# EasyEDA Pro project 硬触发测试_2024-02-21_17-27-05(1).eprj, board PCB1 (continued)
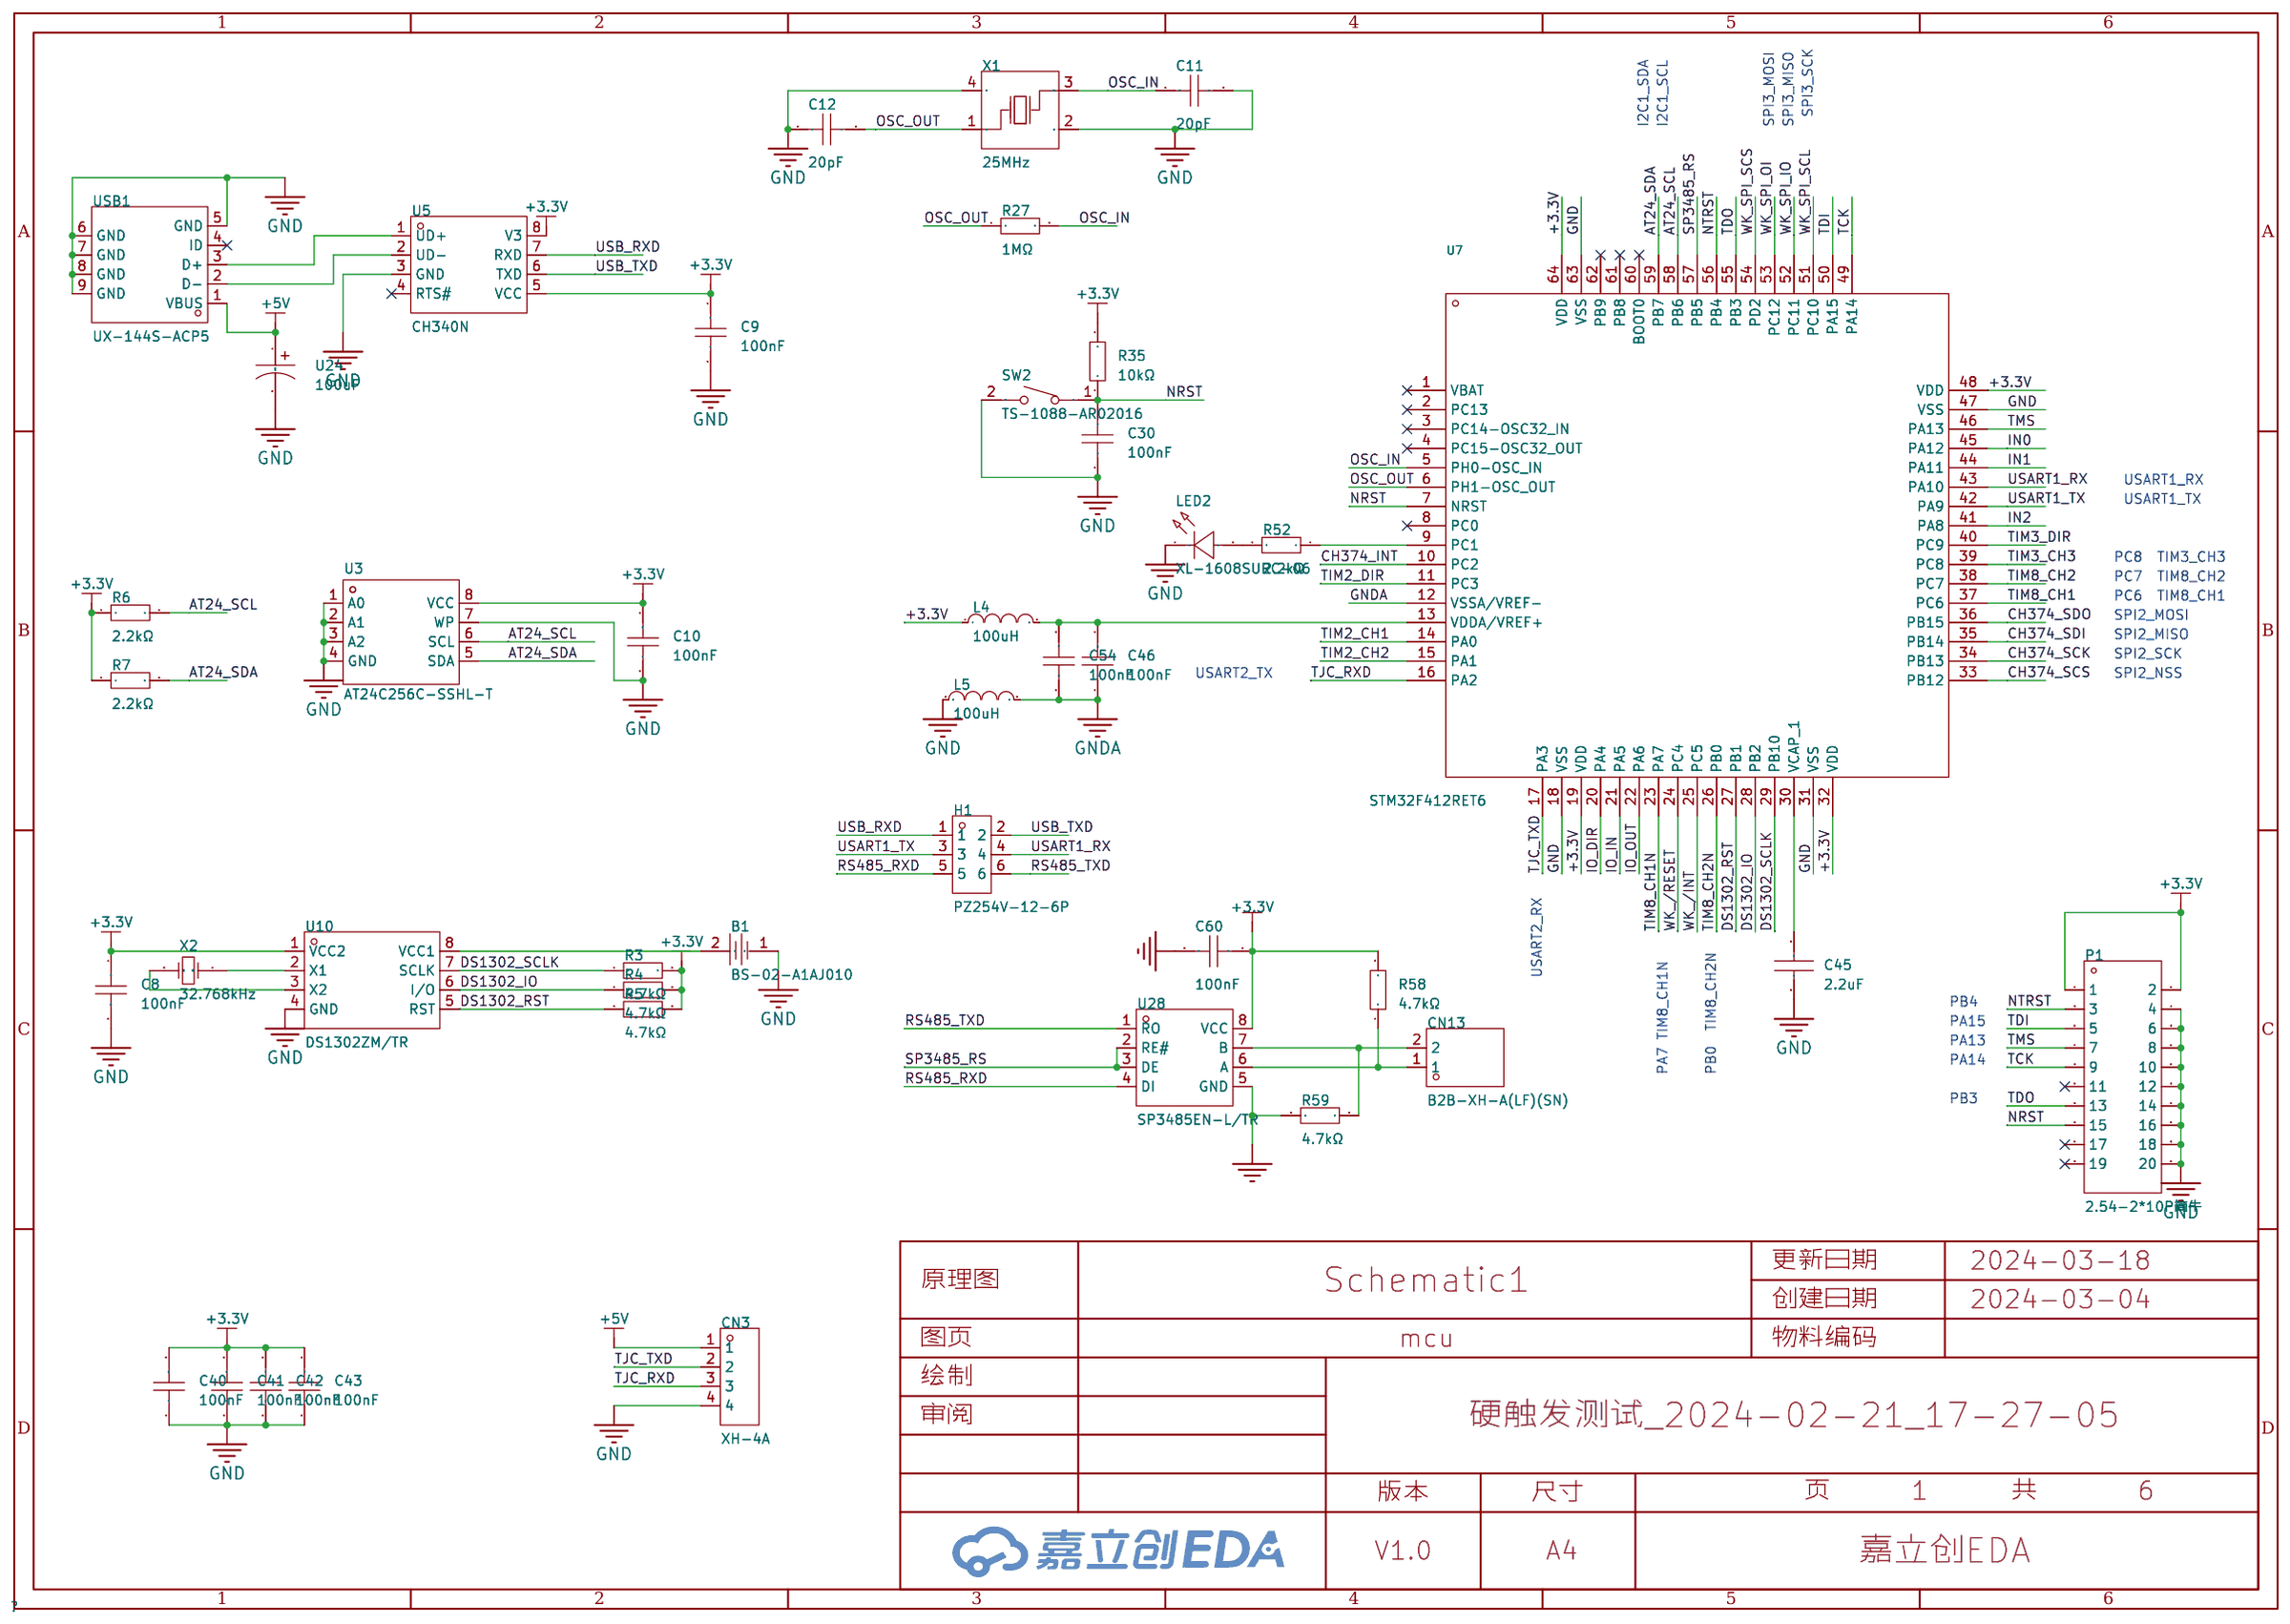
[diagram p0: mcu]
## Routing (per net, layer and track width the routed paths; a pad name or vN(x,y) marks a point on that pad's centre or on a via; arc(x,y) is an arc through that point)
+3.3V: length 416.4
  Top Layer w0.254: 41.13,13.71 41.13,17.59 53.65,30.1 55.63,30.1 57.28,31.75 v1(57.4,31.75) 57.4,28.33 56.64,27.56 56.64,19.92 ; 41.13,13.71 U9.1 ; 41.13,13.71 41.02,13.82 ; v1(61.34,58.3) 61.34,56.36 C43.2 61.51,56.14 60.71,56.14 60.26,56.59 U7.32 ; v1(61.34,58.3) 60.71,58.93 60.71,60.33 61.72,61.35 65.53,61.35 68.83,64.65 71.75,64.65 72.71,65.6 C9.1 72.77,66.74 U5.8 ; v1(61.34,58.3) 62.1,59.06 66.17,59.06 67.18,58.04 R3.2 ; 29.04,68.33 29.08,68.29 29.08,64.01 31.5,61.6 38.35,61.6 v1(39.5,60.46) ; 29.04,68.33 28.45,68.33 27.56,69.22 27.56,73.16 27.93,73.53 R48.2 38.74,73.53 R46.2 46.35,73.66 R44.2 v1(47.42,72.59) 47.94,72.08 C33.1 48.51,71.38 47.62,70.49 47.62,67.82 47.81,67.64 U14.5 ; 29.04,68.33 U3.8 33.09,68.33 C10.1 ; 75.31,18.06 75.21,18.17 71.88,18.17 ; 75.31,18.06 76.58,18.06 76.84,17.81 ; 75.31,18.06 75.31,16.38 ; 71.88,18.17 71.88,16.38 72.65,16.38 72.9,16.13 72.9,14.23 72.5,13.84 U27.1 72.53,12.96 73.91,12.96 74.17,12.71 74.17,11.93 ; 71.88,18.17 70.99,18.17 70.74,18.42 ; U28.8 79.46,13.66 C60.1 77.85,12.2 77.47,12.58 77.47,13.1 U26.1 77.46,13.96 77.72,14.23 77.72,16.26 77.6,16.39 76.84,16.39 R57.2 76.84,17.81 ; 65.34,14.93 64.64,14.23 64.64,13.5 64.63,13.49 ; 65.34,14.93 65.34,17.53 65.09,17.78 60.08,17.78 59.82,17.53 ; 65.34,14.93 C59.2 R54.1 ; L4.1 58.68,38.29 v1(61.47,38.29) ; 56.64,19.92 56.24,19.92 53.34,17.02 53.34,8.26 52.96,7.88 SW1.3 ; 56.64,19.92 69.24,19.92 70.74,18.42 ; 56.64,19.92 56.64,18.36 57.22,17.78 59.56,17.78 59.82,17.53 ; 59.82,17.53 C8.1 59.88,15.12 U20.1 61.07,13.29 C58.1 ; U14.19 U14.20 58.23,70.24 C34.1 59.06,70.94 v1(59.06,71.38) ; 76.84,17.81 77.85,18.82 77.85,20.58 R58.2 77.84,20.58 76.84,20.58 76.2,21.21 R35.2 ; 70.74,18.42 70.74,18.32 70.36,17.93 R42.2 ; P1.1 P1.2 78.74,38.11 75.18,38.11 70.87,42.42 67.82,42.42 66.39,43.85 U10.1 64.45,47.82 63.63,48.65 v1(61.59,48.65) 61.59,48.59 61.56,48.56 C42.2 60.38,49.66 59.95,50.09 U7.19 ; U7.64 44.05,49.09 43.98,49.15
  Top Layer w0.305: U7.48 48.19,59.74 48.25,59.79 C41.2 47.08,60.55 v1(46.99,60.46)
  Top Layer w0.508: 36.7,50.19 38.66,50.19 39.66,51.19 42.67,51.19 43.98,49.88 43.98,49.15 ; 36.7,50.19 36.7,57.66 v1(39.5,60.46) ; 36.7,50.19 C52.1 ; R3.2 R4.2 R5.2 ; U4.2 30.48,44.54 36.24,44.54 C52.1 ; C10.1 33.15,68.12 R6.1 R7.1 ; C52.1 39.75,44.08 40.77,43.06 40.77,37.47 44.96,33.28 55.88,33.28 v1(57.4,31.75) ; U5.8 72.77,71.25 72.52,71.51 69.47,71.51 68.96,71 U5.5
  Bottom Layer w0.254: v1(47.42,72.59) 48,72.01 50.55,72.01 53.59,75.06 58.67,75.06 59.82,73.92 59.82,72.14 v1(59.06,71.38)
  Bottom Layer w0.508: v1(39.5,60.46) v1(46.99,60.46) 46.99,59.44 47.24,59.19 60.45,59.19 v1(61.34,58.3) ; v1(61.59,48.65) 61.59,38.41 v1(61.47,38.29) 57.4,38.29 v1(57.4,31.75)
+5V: length 296.9
  Top Layer w0.254: 73.15,10.16 72.87,9.88 U27.8 ; U16.8 64.63,10.05 64.9,9.78 65.91,9.78 v1(66.17,10.04) C56.2 ; 60.58,10.55 60.53,10.59 59.88,10.59 ; C57.2 79.32,10.18 v1(78.24,10.18) 78.08,10.01 U26.8
  Top Layer w0.508: 59.82,78.49 49.15,78.49 48.01,77.35 48.01,76.38 46.18,74.55 24.89,74.55 23.37,73.03 23.37,63.25 23.88,62.74 27.43,62.74 28.96,61.22 28.96,53.85 28.19,53.09 28.19,50.22 U4.3 ; 59.82,78.49 59.75,78.55 62.23,81.03 68.2,81.03 68.83,81.67 78.49,81.67 79.5,80.65 79.5,75.19 78.35,74.03 U24.1 ; 59.82,78.49 60.96,77.35 60.96,73.4 USB2.1 61.03,71.05 62.37,69.72 U25.1 ; U24.1 75.07,74.03 74.39,74.72 USB1.1 ; U24.1 77.34,72.01 77.72,71.63 78.68,71.63 79.76,70.56 79.76,67.95 85.6,62.11 85.6,32.64 ; v1(4.44,52.08) R1.2 ; U4.3 28.09,50.3 21.59,50.3 20.7,49.41 20.7,44.71 19.41,43.41 L1.2 v1(12.32,46.61) ; U4.3 28.18,44.31 25.92,42.06 U12.3 28.67,38.57 C13.2 ; 85.6,32.64 85.54,32.58 CN3.1 ; 85.6,32.64 85.6,26.55 84.58,25.53 84.58,20.71 81.91,18.04 81.91,14.1 82.42,13.59 82.42,9.28 81.53,8.39 80.14,8.39 79.5,9.02 79.5,10.23 C57.2
  Bottom Layer w0.254: SW1.1 52.14,3.88 54.74,6.48 54.74,8.81 56.47,10.55 v1(60.56,10.55) 65.66,10.55 v1(66.17,10.04) 66.3,10.18 v1(73.11,10.18) v1(78.24,10.18)
  Bottom Layer w0.508: v1(4.44,52.08) 6.86,52.08 7.6,51.33 7.6,48.28 9.27,46.61 v1(12.32,46.61)
  vias: v1(7.37,33.41)
GND: length 77.2
  Top Layer w0.254: v1(31.12,33.03) 30.99,32.9 30.99,29.34 30.09,28.44 U2.29 ; U2.9 30.59,15.39 30.67,15.31 ; v1(60.71,16.77) 62.1,16.77 62.61,16.26 62.61,14.99 63.13,14.47 63.13,13.49 ; 27.59,18.74 27.59,17.94 27.18,17.53 25.91,17.53 25.4,18.04 v1(25.4,18.17) ; 30.67,15.31 30.73,15.25 33.65,15.25 R29.1 ; 30.67,15.31 C21.1 ; v1(44.45,50.81) 44.45,50.2 45.07,49.59 U7.63 ; v1(60.45,48.39) 60.45,48.77 59.64,49.59 U7.18 ; U2.14 34.46,20.74 35.01,20.2 36.83,20.2 37.08,19.94 37.08,19.37 C22.1 ; C45.1 62.65,56.15 C43.1 62.63,55.65 62.48,55.5 60.58,55.5 60,56.09 U7.31 ; P1.4 P1.6 P1.8 P1.10 P1.12 P1.14 P1.16 P1.18 P1.20 ; 35.18,22.61 35.18,22.36 34.56,21.74 U2.16 ; 35.18,22.61 34.8,22.99 34.8,23.12 34.68,23.24 U2.19 ; 35.18,22.61 36.7,22.61 37.02,22.93 C23.1 ; C41.1 48.86,61.64 49.02,61.47 49.02,60.04 48.69,59.71 U7.47 ; U27.4 69.88,12.99 v1(69.85,12.96) ; R26.2 R25.2 R31.1 19.43,24.9 v1(18.92,25.41)
  vias: v1(2.41,52.08) v1(3.3,52.08) v1(3.43,45.72) v1(3.43,44.45) v1(4.49,45.7) v1(4.49,44.46) v1(5.46,45.72) v1(5.46,44.45) v1(8.25,26.29) v1(8.51,20.2) v1(10.92,27.56) v1(14.86,29.72) v1(17.05,27.05) v1(17.53,79.13) v1(20.7,17.4) v1(22.48,18.93) v1(22.61,28.83) v1(22.73,30.1) v1(24.51,26.55) v1(24.77,71.89) v1(25.4,27.94) v1(27.69,21.09) v1(28.52,30.85) v1(29.34,21.85) v1(29.72,67.06) v1(29.84,69.6) v1(33.91,70.48) v1(36.96,64.27) v1(38.61,32.39) v1(40.51,9.4) v1(41.15,70.11) v1(41.53,49.15) v1(43.31,41.83) v1(46.74,70.24) v1(46.99,61.73) v1(51.31,69.22) v1(51.82,65.16) v1(52.96,70.49) v1(53.59,35.06) v1(53.59,31.75) v1(53.59,26.93) v1(54.36,69.22) v1(58.04,47) v1(58.42,67.44) v1(61.59,9.66) v1(63.37,58.17) v1(65.02,49.79) v1(65.02,27.44) v1(65.15,58.17) v1(67.18,16.51) v1(67.44,12.83) v1(75.06,71.89) v1(75.06,70.62) v1(75.06,69.22) v1(75.06,12.96) v1(77.09,44.58) v1(77.22,47.12) v1(77.85,26.55) v1(79.25,19.06) v1(85.34,19.18) v2(3.51,61.14) v2(3.51,24.72) v2(3.63,83.33) v2(3.69,3.88) v2(71.01,61.22) v2(71.01,24.72) v2(83.13,83.33) v2(83.19,3.88)
GNDA: length 10
  Top Layer w0.254: L5.2 56.13,40.42 56.13,41.79 56.39,42.04 C54.1 57.02,42.08 57.02,43.82 56.64,44.2 54.83,44.2 53.69,45.33 U7.12
+IN0: length 4.2
  Top Layer w0.254: R45.2 46.61,80.19 44.55,82.25
+IN1: length 4.1
  Top Layer w0.254: CN6.1 38.11,80.78 R47.2
+IN2: length 4.9
  Top Layer w0.254: R49.2 30.48,78.75 30.48,81.54 29.77,82.25 CN7.1
-IN0: length 3.8
  Top Layer w0.254: 41.28,78.74 41.28,80.52 42.01,81.26 42.01,82.25
-IN1: length 3.7
  Top Layer w0.254: CN6.2 34.1,78.8 U22.2
-IN2: length 3.8
  Top Layer w0.254: CN7.2 26.29,82.09 U23.2
ACTLED: length 35.3
  Top Layer w0.254: U2.27 31.09,22.84 30.1,21.85 v1(30.1,20.83)
  Bottom Layer w0.254: v1(30.1,20.83) 30.1,19.82 29.74,19.46 29.74,14.51 23.5,8.26 13.1,8.26 J1.10
AT24_SCL: length 26.8
  Top Layer w0.254: U3.6 31.22,65.3 31.37,65.16 32.52,65.16 R6.2 33.9,65.28 39.12,65.28 41.91,62.49 41.91,53.47 43.29,52.09 U7.58
AT24_SDA: length 27
  Top Layer w0.254: 34.76,63.25 31.88,63.25 31.22,63.91 U3.5 ; 34.76,63.25 40,63.25 41.28,61.98 41.28,53.47 43.16,51.59 U7.59 ; 34.76,63.25 34.8,63.29 R7.2
CH374_INT: length 43.8
  Top Layer w0.254: U7.10 52.69,48.28 53.95,49.54 53.95,53.7 54.55,54.3 55.69,54.3 56.18,54.79 56.18,57.45 56.68,57.95 56.68,61.63 59.95,64.91 59.95,73.66 58.93,74.68 53.47,74.68 50.67,71.88 49.91,71.88 49.22,71.2 U14.1
CH374_SCK: length 10.7
  Top Layer w0.254: U7.34 55.19,61.53 54.13,62.59 54.13,66.58 54.54,66.99 U14.15
CH374_SCS: length 9.2
  Top Layer w0.254: U7.33 55.69,61.79 54.48,63 54.48,65.54 54.64,65.69 U14.13
CH374_SDI: length 11.5
  Top Layer w0.254: U7.35 54.69,61.52 53.77,62.44 53.77,66.98 54.43,67.64 U14.16
CH374_SDO: length 12.3
  Top Layer w0.254: U7.36 54.19,61.51 53.42,62.29 53.42,67.39 54.31,68.29 U14.17
CH374T_XI: length 8.9
  Top Layer w0.254: C32.2 44.29,70.23 44.29,68.34 44.32,68.31 44.32,67.57 44.7,67.19 46.99,67.19 47.62,66.55 47.62,65.69 U14.8
CH374T_XO: length 5.8
  Top Layer w0.254: C31.2 45.99,64.41 X4.3 46.02,66.17 46.99,66.17 47.12,66.05 47.12,65.54 47.61,65.04 U14.9
DS1302_IO: length 16
  Top Layer w0.254: R4.1 68.93,55.13 U10.6 68.93,52.13 68.39,51.59 62.84,51.59 59.85,54.59 U7.28
DS1302_RST: length 17.7
  Top Layer w0.254: R5.1 70.29,53.28 U10.5 70.2,51.49 69.94,51.24 62.7,51.24 59.83,54.11 57.71,54.11 U7.27
DS1302_SCLK: length 14.7
  Top Layer w0.254: R3.1 67.66,54.87 U10.7 67.66,52.3 67.31,51.95 62.99,51.95 59.85,55.09 U7.29
IN0: length 29
  Top Layer w0.254: 31.24,71.89 31.24,70.62 32.26,69.6 35.94,69.6 42.77,62.77 48.31,62.77 48.82,62.26 48.87,62.26 49.69,61.44 U7.45 ; 31.24,71.89 R48.1 ; 31.24,71.89 U23.4
IN1: length 23.7
  Top Layer w0.254: U7.44 50.19,61.44 48.51,63.12 43.43,63.12 38.86,67.69 R46.1 38.73,72.02 U22.4
IN2: length 25
  Top Layer w0.254: R44.1 43.94,72.02 U21.4 43.18,72.14 42.29,71.25 42.29,65.03 43.69,63.63 50.29,63.63 51.69,62.23 U7.41
IO_DIR: length 48.1
  Top Layer w0.254: v1(54.86,22.99) 53.57,22.99 45.59,15.02 45.59,13.85 45.21,13.47 45.21,12.45 45.45,12.21 U9.5 ; U7.20 59.47,50.59 v1(59.56,50.68)
  Bottom Layer w0.254: v1(59.56,50.68) 54.86,45.98 v1(54.86,22.99)
IO_IN: length 44.7
  Top Layer w0.254: v1(55.75,50.17) 56.67,51.09 U7.21 ; v1(53.59,24.26) 44.45,15.12 44.45,13.97 43.68,13.21 U9.2
  Bottom Layer w0.254: v1(53.59,24.26) 54.15,24.82 54.15,47.05 55.75,48.65 v1(55.75,50.17)
IO_OUT: length 48
  Top Layer w0.254: v1(54.23,23.63) 53.47,23.63 44.96,15.12 44.96,13.72 43.95,12.71 U9.3 ; U7.22 59.08,51.59 59.1,51.57 v1(59.31,51.57)
  Bottom Layer w0.254: v1(59.31,51.57) 54.51,46.77 54.51,23.91 v1(54.23,23.63)
LINKLED: length 27.9
  Top Layer w0.254: U2.25 32.09,26.5 31.5,25.91 31.5,21.09 v1(31.12,20.71)
  Bottom Layer w0.254: J1.11 20.89,7.88 23.75,7.88 30.1,14.23 30.1,19.31 31.12,20.33 v1(31.12,20.71)
NRST: length 102.7
  Top Layer w0.254: C30.1 78.55,29.28 78.74,29.09 78.74,28.83 78.99,28.58 SW2.1 ; v1(49.78,52.96) 49.78,50.17 51.18,48.77 51.18,47.1 U7.7 51.19,45.71 53.72,43.19 53.72,36.93 58.55,32.11 58.55,23.28 59.34,22.48 64.76,22.48 67.69,25.41 67.69,27.58 68.71,28.61 73.42,28.61 74.16,29.34 R35.1 77.6,29.34
  Bottom Layer w0.254: P1.15 80.14,54.74 73.79,54.74 71.12,57.41 47.5,57.41 46.74,56.65 46.74,53.47 47.75,52.46 48.63,52.46 49.14,52.96 v1(49.78,52.96)
NTRST: length 43.5
  Top Layer w0.254: U7.56 48.51,53.09 v1(48.51,53.09)
  Bottom Layer w0.254: P1.3 80.14,42.04 78.47,42.04 76.2,44.31 76.2,49.03 71.63,53.6 49.02,53.6 v1(48.51,53.09)
OSC_IN: length 14.8
  Top Layer w0.254: U7.5 50.19,45.46 49.54,44.81 46.84,44.81 45.86,43.83 R27.2 46.48,42.03 46.48,39.25 46.22,38.98 X1.3 45.44,39.03 C11.1
OSC_OUT: length 11.2
  Top Layer w0.254: C12.2 47.86,40.56 X1.1 47.37,41.05 47.37,42.65 ; 47.37,42.65 R27.1 ; 47.37,42.65 47.37,44.07 47.62,44.33 49.56,44.33 50.69,45.45 50.67,45.47 50.67,47.07 U7.6
OUT1: length 2.5
  Top Layer w0.254: 77.92,7.88 76.96,8.84 U26.7
OUT2: length 2.6
  Top Layer w0.254: 75.42,7.88 76.46,8.92 U26.6
OUT3: length 2.4
  Top Layer w0.254: 72.92,7.88 72,8.79 U27.7
OUT4: length 2.5
  Top Layer w0.254: 70.42,7.88 71.5,8.97 U27.6
PMODE0: length 27.2
  Top Layer w0.254: R29.2 v1(34.91,16.76) 37.2,16.76 38.23,17.78 38.23,20.96 37.97,21.21 R32.1 ; v1(26.54,23.12) 26.54,22.36 25.93,21.74 25.09,21.74
  Bottom Layer w0.254: v1(34.91,16.76) 34.91,22.5 33.53,23.88 30.92,23.88 29.78,22.74 27.24,22.74 26.86,23.12 v1(26.54,23.12)
PMODE1: length 9.7
  Top Layer w0.254: 25.09,22.24 24.14,22.24 23.62,21.72 23.62,17.15 23.88,16.9 24.38,16.9 24.51,16.76 R30.2 R33.1
PMODE2: length 8.6
  Top Layer w0.254: 25.09,22.74 25.08,22.74 23.75,22.74 23.47,22.46 23.47,22.21 22.99,21.72 19.94,21.72 19.43,22.23 R31.2 R34.1
RCT: length 17.8
  Top Layer w0.254: 12.83,21.59 12.7,21.59 12.32,21.21 11.18,21.21 10.41,21.98 10.41,25.79 10.98,26.36 C20.1 ; 12.83,21.59 13.33,21.09 13.33,19.56 14.1,18.8 14.64,18.8 J1.5 ; 12.83,21.59 R16.2 R15.2
RS485_RXD: length 59.7
  Top Layer w0.254: H1.5 86.49,73.41 86.49,17.91 86.23,17.66 U28.4
RS485_TXD: length 68.5
  Top Layer w0.254: v1(86.11,13.85) U28.1
  Bottom Layer w0.254: H1.6 83.82,76.59 85.85,76.59 86.11,76.33 v1(86.11,13.85)
RXN: length 21.5
  Top Layer w0.254: C19.1 11.23,24.51 v1(12.83,24.51) ; U2.5 28.59,19.81 28.57,19.82 v1(28.57,20.2)
  Bottom Layer w0.254: v1(12.83,24.51) 13.39,23.95 13.39,23.65 14.96,22.08 26.76,22.08 27.12,21.72 27.91,21.72 28.75,20.88 28.75,20.75 28.57,20.58 v1(28.57,20.2)
RXNNET: length 7.8
  Top Layer w0.254: C19.2 11.18,22.61 11.94,21.85 v1(12.06,21.85)
  Bottom Layer w0.254: J1.6 16.35,20.11 14.22,22.23 12.45,22.23 v1(12.06,21.85)
RXP: length 21.6
  Top Layer w0.254: v1(29.34,20.2) 29.34,19.82 29.09,19.57 U2.6 ; v1(14.35,24.51) 15.95,24.51 C18.1
  Bottom Layer w0.254: v1(14.35,24.51) 13.79,23.95 13.79,23.82 15.13,22.48 26.93,22.48 27.28,22.13 28.08,22.13 29.16,21.05 29.16,20.75 29.34,20.58 v1(29.34,20.2)
RXPNET: length 7.9
  Top Layer w0.254: v1(13.97,21.47) 14.35,21.85 15.62,21.85 16,22.23 C18.2
  Bottom Layer w0.254: J1.3 13.33,18.54 13.78,18.99 13.33,19.44 13.33,21.21 13.59,21.47 v1(13.97,21.47)
SP3485_RS: length 108.5
  Top Layer w0.254: v1(82.8,16.39) U28.3 U28.2 ; U7.57 43.68,52.59 42.67,53.6 v1(42.67,61.6)
  Bottom Layer w0.254: v1(42.67,61.6) 43.56,62.49 48.64,62.49 49.91,61.22 60.32,61.22 61.47,62.36 65.02,62.36 68.07,65.41 83.95,65.41 83.95,17.53 v1(82.8,16.39)
TCK: length 38.6
  Top Layer w0.254: U7.49 48.83,56.59 v1(49.66,55.76)
  Bottom Layer w0.254: v1(49.66,55.76) 71.37,55.76 77.47,49.66 80.14,49.66 P1.9
TCT: length 10.2
  Top Layer w0.254: J1.4 15.58,21.09 16,21.09 17.02,22.1 17.02,26.29 16.96,26.36 C16.1 16.08,26.3 R14.2
TDI: length 42.2
  Top Layer w0.254: U7.50 48.19,56.09 v1(48.9,55.38)
  Bottom Layer w0.254: P1.5 80.14,44.58 78.47,44.58 76.68,46.37 76.68,49.31 71.75,54.23 50.04,54.23 v1(48.9,55.38)
TDO: length 40.9
  Top Layer w0.254: v1(48.26,54.11) 47.74,53.59 U7.55
  Bottom Layer w0.254: v1(48.26,54.11) 47.62,54.74 47.62,56.27 47.88,56.52 71.37,56.52 75.69,52.2 80.14,52.2 P1.13
TIM2_CH1: length 43.9
  Top Layer w0.254: v1(64.52,15.75) 64.13,15.37 64.13,13.49 ; v1(64.26,30.36) 64.9,30.99 64.9,39.25 59.08,45.06 55.4,45.06 54.69,45.77 U7.14
  Bottom Layer w0.254: v1(64.26,30.36) 64.26,24.52 62.74,22.99 62.74,14.99 63.75,14.99 v1(64.52,15.75)
TIM2_CH2: length 41.5
  Top Layer w0.254: v1(63.37,15.75) 63.75,15.37 63.75,14.23 63.63,14.11 63.63,13.49 ; v1(65.41,30.36) 65.41,39.24 59.23,45.42 55.68,45.42 55.19,45.9 U7.15
  Bottom Layer w0.254: v1(65.41,30.36) 66.04,29.72 66.04,25.53 63.37,22.86 v1(63.37,15.75)
TIM2_DIR: length 40.8
  Top Layer w0.254: U7.11 53.19,44.73 54.61,43.31 54.61,37.05 59.82,31.84 v1(59.82,24.64) ; U16.5 63.13,12.19 62.48,12.83 62.48,13.21 61.72,13.97 v1(61.72,15.37)
  Bottom Layer w0.254: v1(61.72,15.37) 61.72,22.74 v1(59.82,24.64)
TIM3_CH3: length 49.8
  Top Layer w0.254: v1(51.69,51.95) 51.69,53.47 52.69,54.48 U7.39 ; U20.3 57.9,13.21 v1(56.9,13.21)
  Bottom Layer w0.254: v1(51.69,51.95) 50.85,51.11 50.85,49.01 51.23,48.63 51.23,22.19 54.89,18.53 54.89,17 56.9,15 v1(56.9,13.21)
TIM3_DIR: length 53.5
  Top Layer w0.254: v1(52.58,50.17) 51.05,51.69 51.05,53.47 52.19,54.61 U7.40 ; 58.93,10.59 58.93,11.56 58.55,11.94 56.64,11.94 55.88,12.71 55.88,16.9 v1(56.39,17.4)
  Bottom Layer w0.254: v1(52.58,50.17) 52.35,49.95 52.35,22.58 56.39,18.55 v1(56.39,17.4)
TIM8_CH1: length 72.8
  Top Layer w0.254: U26.2 76.96,14.75 R57.1 76.83,14.86 76.2,14.86 76.07,14.99 v1(76.07,17.53) ; U7.37 53.69,54.33 53.09,53.73 v1(53.09,51.82)
  Bottom Layer w0.254: v1(76.07,17.53) 76.07,17.91 75.82,18.17 70.99,18.17 67.31,14.48 58.42,14.48 55.65,17.25 55.65,18.77 51.94,22.48 51.94,49.03 51.69,49.28 51.69,50.55 52,50.86 52.49,50.86 53.09,51.45 v1(53.09,51.82)
TIM8_CH1N: length 67
  Top Layer w0.254: U26.3 76.46,13.84 76.45,13.85 v1(75.31,13.85) R56.1 ; v1(57.78,20.45) v1(65.66,20.45) ; U7.23 56.57,52.09 55.12,50.64 v1(55.12,50.55)
  Bottom Layer w0.254: v1(57.78,20.45) 55.5,20.45 53.06,22.89 53.06,47.37 55.12,49.42 v1(55.12,50.55) ; v1(65.66,20.45) 75.56,20.45 77.6,18.42 77.6,15.37 76.07,13.85 v1(75.31,13.85)
TIM8_CH2: length 68.1
  Top Layer w0.254: U7.38 53.19,54.47 52.32,53.6 v1(52.32,51.44) ; U27.2 72,14.76 R55.1 71.87,14.86 71.25,14.86 71.12,14.99 v1(71.12,17.53)
  Bottom Layer w0.254: v1(71.12,17.53) 67.69,14.1 58.29,14.1 55.25,17.15 55.25,18.68 51.59,22.34 51.59,48.88 51.21,49.26 51.21,50.81 51.84,51.44 v1(52.32,51.44)
TIM8_CH2N: length 60
  Top Layer w0.254: U7.26 54.84,53.59 54.48,53.23 v1(54.48,49.53) ; U27.3 71.5,13.49 71.14,13.85 70.74,13.85 70.36,14.23 R42.1 70.35,14.86 69.47,14.86 69.34,14.99 69.34,17.66 67.82,19.18 58.42,19.18 v1(58.04,18.8)
  Bottom Layer w0.254: v1(58.04,18.8) 57.55,18.8 57.3,19.06 56.39,19.06 52.71,22.73 52.71,47.76 v1(54.48,49.53)
TJC_RXD: length 18.7
  Top Layer w0.254: U7.16 55.69,46.04 55.88,45.85 59.31,45.85 67.58,37.58 CN3.3
TJC_TXD: length 23
  Top Layer w0.254: CN3.2 70.99,36.22 70.99,38.36 70.49,38.87 66.8,38.87 59.56,46.1 59.56,48.65 59.12,49.09 U7.17
TMS: length 39.4
  Top Layer w0.254: U7.46 49.19,57.11 49.78,56.52 50.8,56.52 51.44,55.89 v1(51.44,55)
  Bottom Layer w0.254: P1.7 80.14,47.12 78.47,47.12 77.27,48.33 77.27,49.23 71.5,55 v1(51.44,55)
TXN: length 36.9
  Top Layer w0.254: 26.59,18.74 26.59,19.62 26.63,19.67 26.63,20.29 26.6,20.33 v1(26.54,20.33) ; R11.2 8.78,22.38 8.78,22.25 10.48,20.54 10.48,19.13 10.57,19.04 11.97,19.04 12.06,19.13 J1.2
  Bottom Layer w0.254: J1.2 12.06,19.47 11.51,18.92 11.38,18.92 10.84,19.46 9.99,19.46 8.48,17.95 8.48,16.73 9.97,15.25 20.65,15.25 22.17,16.76 22.17,17.6 24.89,20.33 v1(26.54,20.33)
TXP: length 37.1
  Top Layer w0.254: J1.1 10.79,18.54 10.7,18.63 10.41,18.63 10.08,18.96 10.08,20.38 8.37,22.08 8.37,22.38 R10.2 ; v1(27.43,20.33) 27.43,19.89 27.09,19.54 27.09,18.74
  Bottom Layer w0.254: v1(27.43,20.33) 27.43,20.37 26.71,21.09 22.61,21.09 21.59,20.07 21.59,16.77 20.57,15.75 10.03,15.75 8.89,16.9 8.89,17.78 10.16,19.06 10.67,19.06 11.16,18.57 11.16,17.93 J1.1
USART1_RX: length 40.6
  Top Layer w0.254: U7.43 50.67,58.61 50.67,61.47 50.29,61.85 v1(50.29,62.62)
  Bottom Layer w0.254: v1(50.29,62.62) 50.29,63.12 51.31,64.14 58.55,64.14 66.93,72.52 H1.4
USART1_TX: length 42.8
  Top Layer w0.254: U7.42 51.19,61.84 v1(51.05,61.98)
  Bottom Layer w0.254: H1.3 83.57,71.25 72.9,71.25 72.14,72.01 67.44,72.01 59.06,63.63 51.82,63.63 51.05,62.87 v1(51.05,61.98)
USB_RXD: length 17.5
  Top Layer w0.254: v1(71.5,70.74) U5.7
  Bottom Layer w0.254: H1.1 84.84,68.58 84.58,68.33 73.91,68.33 v1(71.5,70.74)
USB_TXD: length 14.6
  Top Layer w0.254: v1(70.23,70.74) U5.6
  Bottom Layer w0.254: v1(70.23,70.74) 70.23,70.87 70.74,71.38 71.88,71.38 73.28,69.98 H1.2
W5500_XI: length 13.3
  Top Layer w0.254: R28.1 v1(25.4,32.52) ; C28.2 29.75,32.07 v1(29.5,31.81) 30.43,31.81 30.61,31.63 30.61,29.47 29.59,28.45 U2.30
  Bottom Layer w0.254: 29.46,31.88 28.83,32.52 v1(25.4,32.52)
W5500_XO: length 10.3
  Top Layer w0.254: R28.2 25.47,30.06 ; 25.47,30.06 26.16,30.75 26.16,32.7 C27.1 ; 25.47,30.06 X3.3 27.3,29.35 27.81,28.83 28.7,28.83 29.09,28.45 U2.31
WK_+1.2V: length 2.3
  Top Layer w0.254: C24.2 35.18,25.28 34.64,24.74 U2.22
WK_+3.3A: length 97
  Top Layer w0.254: 32,22.24 32,21.21 ; 32,22.24 32,23.99 32.26,24.24 ; 32,22.24 U2.17 ; 32,21.21 32,20.06 31.89,19.94 ; 32,21.21 33.56,21.21 U2.15 35.54,21.24 R32.2 ; C21.2 27.12,15.25 R33.2 ; C21.2 29.66,16.71 30.09,17.14 U2.8 30.1,18.75 30.1,19.69 30.35,19.94 31.59,19.94 ; C21.2 28.57,17.4 28.09,17.89 U2.4 ; 31.59,19.94 31.59,19.92 ; 31.59,19.94 31.61,19.94 ; 31.59,19.92 31.61,19.94 ; 31.59,19.92 U2.11 ; 31.61,19.94 31.89,19.94 ; C22.2 33.27,19.31 32.64,19.94 31.89,19.94 ; 32.26,24.24 U2.21 ; 32.26,24.24 32.26,26.04 32.89,26.67 32.89,26.93 35.43,29.47 35.43,30.62 36.44,31.63 39.5,31.63 40.77,32.9 40.77,34.93 40.13,35.56 38.48,35.56 36.83,33.91 32.89,33.91 30.86,35.95 v1(27.23,35.95) U13.1 ; R34.2 18.03,24.51 v1(18.03,25.22) C17.1 18.73,26.36 18.92,26.55 18.92,28.33 18.54,28.71 15.49,28.71 15.11,28.33 15.11,27.94 14.98,27.81 R14.1 14.35,28.58 13.84,29.09 10.8,29.09 9.4,27.69 R11.1 R10.1
  Bottom Layer w0.254: v1(18.03,25.22) 18.41,24.85 20.27,24.85 24.29,28.87 24.29,33.06 27.18,35.95
WK_+3.3D: length 68.2
  Top Layer w0.254: R8.1 R9.1 3.82,19.95 6.48,22.61 6.48,27.18 10.03,30.74 16.26,30.74 17.4,29.6 19.95,29.6 R20.2 ; U13.2 24.83,35.3 24.89,35.23 30.94,35.23 31.75,34.42 31.75,30.1 32,29.85 32.7,29.85 R21.2 32.77,28.81 32.53,28.58 30.73,28.58 30.59,28.43 U2.28
  Top Layer w0.508: R20.2 R19.2 18.54,30.99 17.66,31.88 C53.1 22.1,34.93 22.4,35.23 C14.2 23.6,35.95 ; 23.6,35.95 U13.2 ; 23.6,35.95 23.62,35.97 U12.2 U12.4
WK_/INT: length 64.3
  Top Layer w0.254: U7.25 55.37,53.09 v1(55.25,52.96) ; R20.1 22.73,29.47 24.96,27.24 26.59,27.24 26.59,25.62 27.05,25.16 v1(27.05,23.88)
  Bottom Layer w0.254: v1(27.05,23.88) 27.05,23.5 27.43,23.12 29.33,23.12 31.89,25.67 31.89,27.95 38.86,34.93 38.86,51.73 39.08,51.95 49.66,51.95 50.67,52.96 v1(55.25,52.96)
WK_/RESET: length 53.7
  Top Layer w0.254: v1(39.62,34.17) 38.99,34.17 38.23,33.41 v1(32.38,33.41) 32.77,33.03 R21.1 ; v1(26.42,24.64) 26.42,25.29 25.96,25.74 25.09,25.74 ; U7.24 55.76,52.59 v1(55.25,52.08)
  Bottom Layer w0.254: v1(32.38,33.41) 26.55,27.57 26.55,24.77 v1(26.42,24.64) ; v1(55.25,52.08) 54.74,52.58 50.8,52.58 49.15,50.93 48.77,50.93 39.62,41.79 v1(39.62,34.17)
WK_SPI_IO: length 55.2
  Top Layer w0.254: v1(28.45,24.14) 28.45,25.02 27.56,25.91 27.56,27.27 ; R19.1 22.86,30.99 23.62,30.23 23.62,29.22 24.13,28.71 27.05,28.71 27.56,28.2 27.56,27.27 ; U7.52 43.85,55.09 v1(43.43,55.5) ; 27.56,27.27 27.59,27.24
  Bottom Layer w0.254: v1(43.43,55.5) 39.12,55.5 36.58,52.96 36.58,35.18 28.45,27.06 v1(28.45,24.14)
WK_SPI_OI: length 47.3
  Top Layer w0.254: U7.53 43.53,54.59 v1(43.43,54.49) ; 27.09,27.24 27.09,25.75 27.69,25.15 v1(27.69,24.64)
  Bottom Layer w0.254: v1(43.43,54.49) 38.99,54.49 37.08,52.58 37.08,35.06 29.19,27.16 29.19,23.86 28.93,23.61 27.96,23.61 27.69,23.88 v1(27.69,24.64)
WK_SPI_SCL: length 46.5
  Top Layer w0.254: U7.51 44.37,55.59 v1(44.07,55.89) ; U2.33 28.09,25.89 29.46,24.52 v1(29.72,24.52)
  Bottom Layer w0.254: v1(29.72,24.52) 30.08,24.52 31.31,25.75 31.31,28.01 38.19,34.89 38.19,52.04 39.22,53.07 44.19,53.07 44.45,53.32 44.45,55.51 v1(44.07,55.89)
WK_SPI_SCS: length 42.2
  Top Layer w0.254: U2.32 28.59,26.03 29.08,25.53 v1(30.1,25.53) ; U7.54 44.18,54.09 v1(43.69,53.6)
  Bottom Layer w0.254: v1(30.1,25.53) 30.1,27.44 37.59,34.93 37.59,52.4 38.79,53.6 v1(43.69,53.6)
$1N3180: length 30.5
  Top Layer w0.254: v1(64.9,52.84) 65.25,53.19 U10.8 ; B1.2 62.48,25.63 v1(62.48,40.77)
  Bottom Layer w0.254: v1(62.48,40.77) 64.01,42.3 64.01,51.95 v1(64.9,52.84)
$1N3382: length 7.4
  Top Layer w0.254: USB1.2 73.59,73.46 73.15,73.03 72.01,73.03 71.5,73.54 U5.2
$1N3387: length 3.1
  Top Layer w0.254: U5.1 72.79,74.46 USB1.3
$1N7315: length 10.5
  Top Layer w0.254: L4.2 58.93,40.47 58.93,41.79 58.67,42.04 C54.2 C46.2 ; U7.13 54.19,45.34 54.98,44.56 57.36,44.56 58.04,43.88 58.04,43.52
$1N7431: length 4.2
  Top Layer w0.254: U7.30 59.99,55.59 60.71,54.87 C45.2
$1N10186: length 51.5
  Top Layer w0.254: U7.9 52.19,45.23 54.23,43.19 54.23,36.93 59.06,32.1 59.06,24.07 59.88,23.25 65.02,23.25 67.19,25.41 67.19,28.21 67.94,28.96 73.03,28.96 75.44,31.37 R52.1
$1N10224: length 1.6
  Top Layer w0.254: R52.2 82.46,31.37 LED2.2
$1N11393: length 7
  Top Layer w0.254: X2.1 72,45.85 68.33,45.85 67.66,46.52 U10.2
$1N11396: length 4.2
  Top Layer w0.254: U10.3 68.93,46.65 69.22,46.36 71.51,46.36 X2.2
$1N12725: length 15.4
  Top Layer w0.254: R59.1 77.98,23.63 CN13.2 81.66,23.63 82.8,22.48 82.8,19.94 82.42,19.56 81.79,19.56 81.28,19.06 81.28,15.88 80.52,15.12 U28.7
$1N12726: length 10.3
  Top Layer w0.254: R58.1 80.45,22.09 CN13.1 80.78,20.4 80.78,16.78 80.39,16.39 U28.6
$2N734: length 13.8
  Top Layer w0.254: U14.6 50.38,66.99 50.51,66.87 51.05,66.87 52.07,67.89 52.07,70.49 52.97,71.39 57.24,71.39 57.33,71.47 57.33,71.6 56.53,72.4 USB2.3
$2N737: length 13.8
  Top Layer w0.254: USB2.2 58.53,72.4 57.73,71.6 57.73,71.31 57.41,70.98 54.29,70.98 52.96,69.65 52.96,68.2 51.22,66.46 50.51,66.46 50.38,66.34 U14.7
$3N345: length 12.4
  Top Layer w0.254: J1.9 5.33,9.61 R8.2
$3N384: length 28.7
  Top Layer w0.254: R9.2 6.1,18.93 6.35,18.67 6.35,15.5 5.72,14.86 5.72,10.55 7.75,8.51 14.35,8.51 18.03,4.83 20.38,4.83 J1.12
$3N1454: length 2.5
  Top Layer w0.254: R17.2 32,17.28 31.62,17.66 31.42,17.66 31.09,17.99 U2.10
$3N1489: length 2.1
  Top Layer w0.254: U2.20 35.38,23.74 C23.2
$3N1750: length 3.6
  Top Layer w0.254: R18.2 34.8,27.06 34.67,26.93 34.67,25.37 34.54,25.24 U2.23
$3N2011: length 2.7
  Top Layer w0.254: 25.09,25.24 24.17,25.24 24,25.41 24,25.96 23.66,26.3 R22.1
$3N2050: length 4.2
  Top Layer w0.254: 21.72,26.18 21.72,25.79 ; 21.74,25.79 22.02,25.51 23.39,25.51 24.16,24.74 25.09,24.74
$3N2089: length 6.4
  Top Layer w0.254: 25.09,24.24 24.16,24.24 23.25,25.15 20.45,25.15 19.81,25.79 R24.1
$3N2128: length 4.5
  Top Layer w0.254: 25.09,23.74 24.21,23.74 24.09,23.63 21.71,23.63 R25.1
$3N2230: length 2.8
  Top Layer w0.254: 25.09,23.24 22.85,23.24 R26.1
$4N379: length 1.8
  Top Layer w0.254: U11.1 6.48,47.87 C1.2
$4N848: length 19.1
  Top Layer w0.254: 6.39,42.39 7.07,42.39 7.62,42.93 7.62,49.41 8.28,50.07 L1.1 11.39,51 C1.1
$4N975: length 3.2
  Top Layer w0.254: U11.4 2.58,49.5 R2.2 3.94,49.54
$4N2465: length 25.7
  Top Layer w0.305: L2.1 20.07,74.44 C36.2 ; LED1.2 22.22,85.01 22.22,85.6 21.97,85.86 17.02,85.86 15.76,84.6 CN4.1
  Top Layer w1.27: CN4.1 15.76,75.82 L2.1
$4N2476: length 38.1
  Top Layer w0.305: CN4.2 13.21,78.88 13.21,75.32 16.76,71.76 20.19,71.76 22.1,73.67 22.1,79.13 21.72,79.51 20.18,79.51 C36.1 R51.1
  Top Layer w1.27: L2.4 10.76,73.13 CN4.2
$4N3697: length 2.8
  Top Layer w0.305: R51.2 20.68,84.96 LED1.1
$5N685: length 4.5
  Top Layer w0.254: U21.1 43.81,77.35 44.2,76.97 46.22,76.97 R45.1
$5N848: length 5.9
  Top Layer w0.254: R47.1 39.62,77.59 38.99,76.97 36.96,76.97 36.45,77.47 U22.1
$5N1008: length 6.2
  Top Layer w0.254: U23.1 28.83,77.35 29.46,76.71 31.37,76.71 32,77.34 R49.1
$5N1278: length 2.8
  Top Layer w0.254: CN12.1 64.71,9.31 64.13,9.89 U16.7
$5N1282: length 3.1
  Top Layer w0.254: U16.6 63.63,9.3 CN12.2
$5N1287: length 3.4
  Top Layer w0.254: CN12.3 57.98,9.61 57.98,10.59
$6N344: length 14.9
  Top Layer w0.254: CN2.1 38.23,5.89 38.23,9.28 40.64,11.69 46.99,11.69 47.12,11.82 47.12,12.58 46.99,12.71 U9.6
$6N345: length 28.6
  Top Layer w0.254: CN1.1 29.12,3.69 39.38,3.69 40.39,4.7 40.39,7.12 44.6,11.33 47.14,11.33 47.47,11.67 47.47,12.17 47.5,12.2 47.5,12.96 47.25,13.21 U9.7
$6N346: length 11.7
  Top Layer w0.254: SW1.2 49.24,5.88 48.26,6.86 48.26,12.96 47.51,13.71 U9.8
$6N3931: length 2
  Top Layer w0.254: 74.17,10.43 74.92,10.43 75.34,10.01 U26.5
$6N3975: length 2.6
  Top Layer w0.254: R54.2 68.72,10.29 69.6,10.29 70,9.88 U27.5

## Copper pours and planes (outline as drawn; the poured copper is in the pictures)
+5V on Top Layer: 5.33,45.34 16.13,45.34 16.13,32.64 5.33,32.64
GND on Top Layer: 0,87 87,87 87,0 0,0
GND on Bottom Layer: 0,87 87,87 87,0 0,0
VCC_IN on Top Layer: 0.38,56.01 5.65,56.01 5.65,38.74 0.38,38.74
$4N848 on Top Layer: 10.16,51.57 20.04,51.57 20.04,48.52 10.16,48.52
$4N2391 on Top Layer: 6.51,67.95 27.96,67.95 27.96,52.33 6.51,52.33

## Text on the board
Bottom Silkscreen Layer: - | + | IN1 | IN2 | IN3 | U盘 | 串口 | 脉冲入 | 脉冲出 | 5 | 3.3 | 网口 | T3 OUT | T8 OUT
Top Silkscreen Layer: U | R | MCCS-042403 | B | A | 运行 | 复位 | 串口 | 电源 | 电平 | 屏幕
